# EAGLE schematic Backplane (EAGLE 7.2.0)

## Sheet 1 of 4
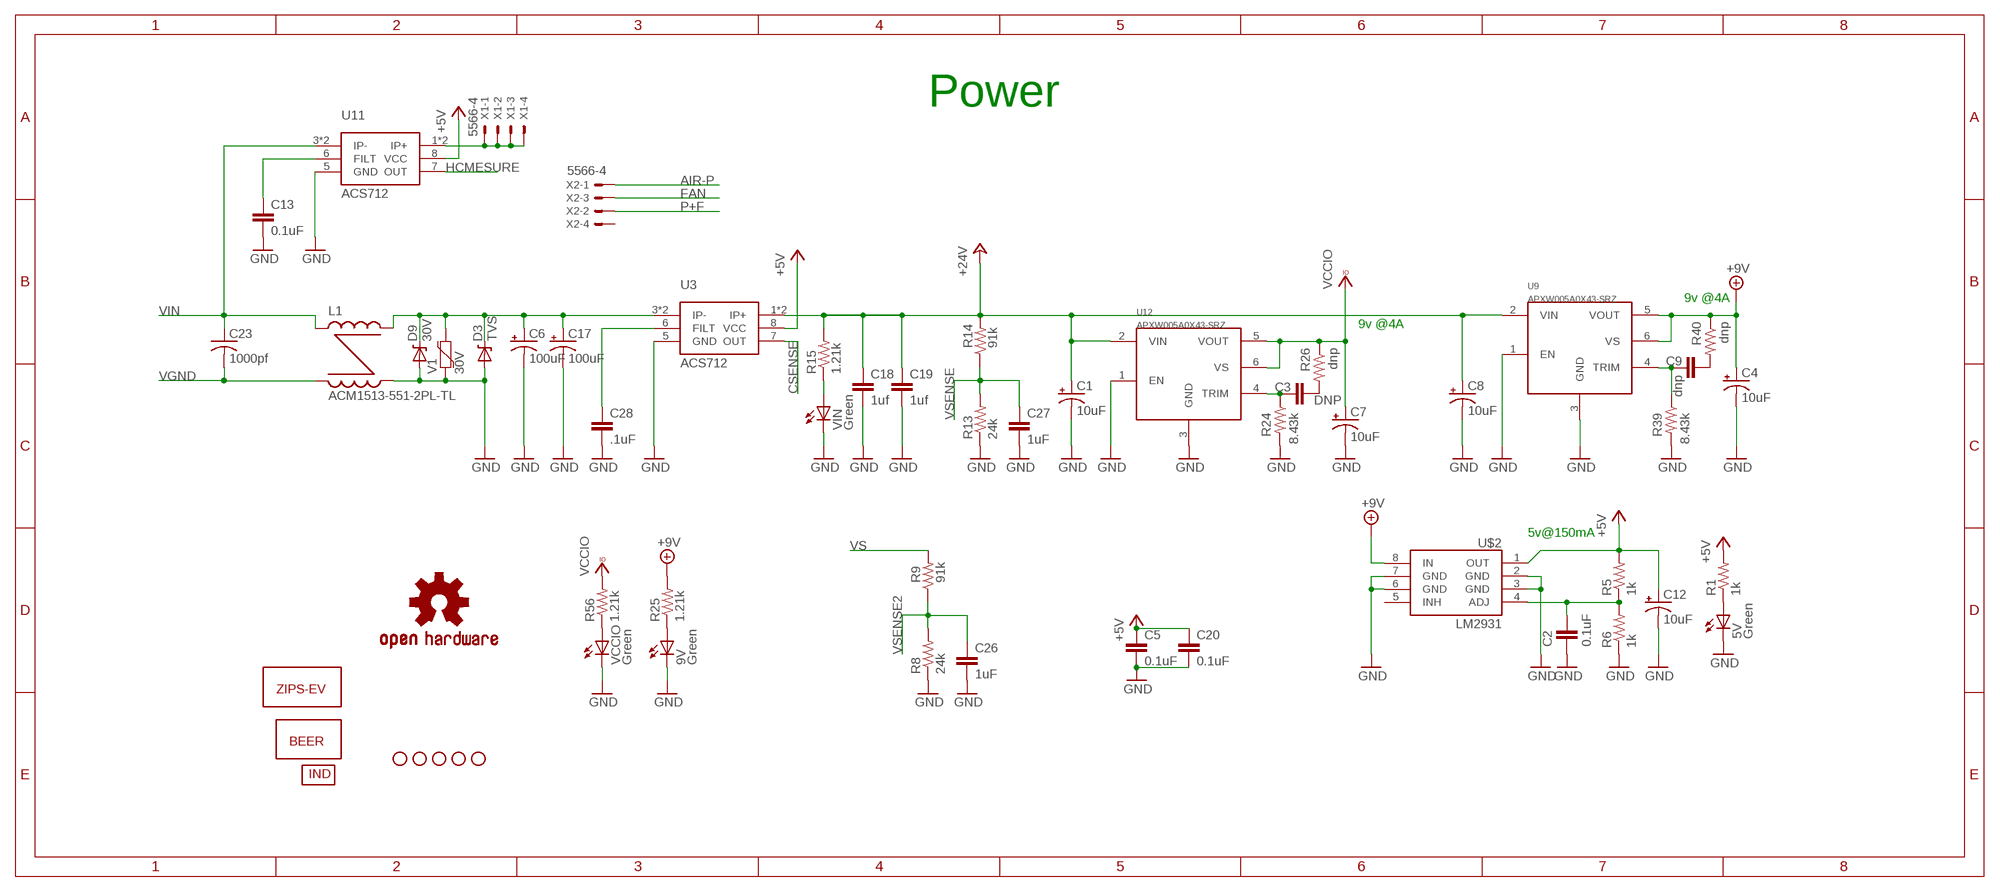
[diagram p0: schematic, sheet 1]

### Parts
5V  Green  LEDCHIP-LED0805  [CHIP-LED0805]
9V  Green  LEDCHIP-LED0805  [CHIP-LED0805]
C1  10uF  CAP_POL7343  [EIA7343]
C2  0.1uF  CAP0805  [0805]
C3  DNP  CAP0805  [0805]
C4  10uF  CAP_POL3528  [EIA3528]
C5  0.1uF  CAP0805  [0805]
C6  100uF  CPOL-USG  [PANASONIC_G]
C7  10uF  CAP_POL3528  [EIA3528]
C8  10uF  CAP_POL7343  [EIA7343]
C9  dnp  CAP0805  [0805]
C12  10uF  CAP_POL3528  [EIA3528]
C13  0.1uF  CAP0805  [0805]
C17  100uF  CPOL-USG  [PANASONIC_G]
C18  1uf  CAP1206  [1206]
C19  1uf  CAP1206  [1206]
C20  0.1uF  CAP0805  [0805]
C23  1000pf  C-USC1825  [C1825]
C26  1uF  CAP0805  [0805]
C27  1uF  CAP0805  [0805]
C28  .1uF  CAP0805  [0805]
D3  TVS  [DO-214AC]
D9  30V  DIODE-ZENERSMB  [SMB-DIODE]
L1  ACM1513-551-2PL-TL  [ACM1513-551-2PL-TL]
R1  1k  R-US_R0805  [R0805]
R5  1k  R-US_R0805  [R0805]
R6  1k  R-US_R0805  [R0805]
R8  24k  R-US_R0805  [R0805]
R9  91k  R-US_R0805  [R0805]
R13  24k  R-US_R0805  [R0805]
R14  91k  R-US_R0805  [R0805]
R15  1.21k  R-US_R0805  [R0805]
R24  8.43k  R-US_R0805  [R0805]
R25  1.21k  R-US_R0805  [R0805]
R26  dnp  R-US_R0805  [R0805]
R39  8.43k  R-US_R0805  [R0805]
R40  dnp  R-US_R0805  [R0805]
R56  1.21k  R-US_R0805  [R0805]
STANDOFF1  STAND-OFF  [STAND-OFF]
STANDOFF2  STAND-OFF  [STAND-OFF]
STANDOFF3  STAND-OFF  [STAND-OFF]
STANDOFF4  STAND-OFF  [STAND-OFF]
STANDOFF5  STAND-OFF  [STAND-OFF]
U3  ACS712  [SO-8]
U9  APXW005A0X43-SRZ  [APXW005A0X43-SRZ]
U11  ACS712  [SO-8]
U12  APXW005A0X43-SRZ  [APXW005A0X43-SRZ]
U$2  LM2931  [SO08]
U$3  BEERL  [B-L]
U$7  LOGO  [L-MS]
U$8  OSHW-LOGOM  [OSHW-LOGO-M]
U$9  INDPK1  [PICKIT-PIN-1]
V1  30V  VARISTOR-0603  [0603-RES]
VCCIO  Green  LEDCHIP-LED0805  [CHIP-LED0805]
VIN  Green  LEDCHIP-LED0805  [CHIP-LED0805]
X1  5566-4  [5566-4]
X2  5566-4  [5566-4]

### Nets
+5V: C5.1 C12.A(+) C20.1 R1.2 R5.2 U3.8(VCC) U11.8(VCC) U$2.1(OUT) ; also sheet 2,4
+9V: C4.A(+) R25.2 R40.1 U9.5(VOUT) U9.6(VS) U$2.8(IN) ; also sheet 2
+24V: C1.A(+) C8.A(+) C18.1 C19.1 R14.2 R15.2 U3.1(IP+) U3.2(IP+) U9.2(VIN) U12.2(VIN) ; also sheet 2,3,4
AIR-P: X2.1 ; also sheet 2
CSENSE: U3.7(OUT) ; also sheet 4
FAN: X2.3 ; also sheet 2
GND: 5V.C 9V.C C1.C(-) C2.2 C4.C(-) C5.2 C6.- C7.C(-) C8.C(-) C12.C(-) C13.2 C17.- C18.2 C19.2 C20.2 C26.2 C27.2 C28.2 D3.A D9.A L1.OUT- R6.1 R8.1 R13.1 R24.2 R39.2 U3.5(GND) U9.1(EN) U9.3(GND) U11.5(GND) U12.1(EN) U12.3(GND) U$2.2(GND) U$2.3(GND) U$2.6(GND) U$2.7(GND) V1.1 VCCIO.C VIN.C ; also sheet 2,3,4
HCMESURE: U11.7(OUT) ; also sheet 4
N$1: R56.1 VCCIO.A
N$3: C2.1 R5.1 R6.2 U$2.4(ADJ)
N$8: 9V.A R25.1
N$18: C28.1 U3.6(FILT)
N$19: 5V.A R1.1
N$30: C6.+ C17.+ D3.C D9.C L1.OUT+ U3.3(IP-) U3.4(IP-) V1.2
N$35: C3.1 R26.2
N$37: C3.2 R24.1 U12.4(TRIM)
N$42: R15.1 VIN.A
N$59: C9.1 R40.2
N$60: C9.2 R39.1 U9.4(TRIM)
N$61: U11.1(IP+) U11.2(IP+) X1.1 X1.2 X1.3 X1.4
N$63: C13.1 U11.6(FILT)
P+F: X2.2 ; also sheet 2
VCCIO: C7.A(+) R26.1 R56.2 U12.5(VOUT) U12.6(VS) ; also sheet 4
VGND: C23.2 L1.IN- ; also sheet 2
VIN: C23.1 L1.IN+ U11.3(IP-) U11.4(IP-) ; also sheet 2
VS: R9.2
VSENSE: C27.1 R13.2 R14.1 ; also sheet 4
VSENSE2: C26.1 R8.2 R9.1
Unconnected: U$2.5(INH) X2.4

### Notes on the sheet
- Power
- 9v @4A
- 9v @4A
- 5v@150mA

## Sheet 2 of 4
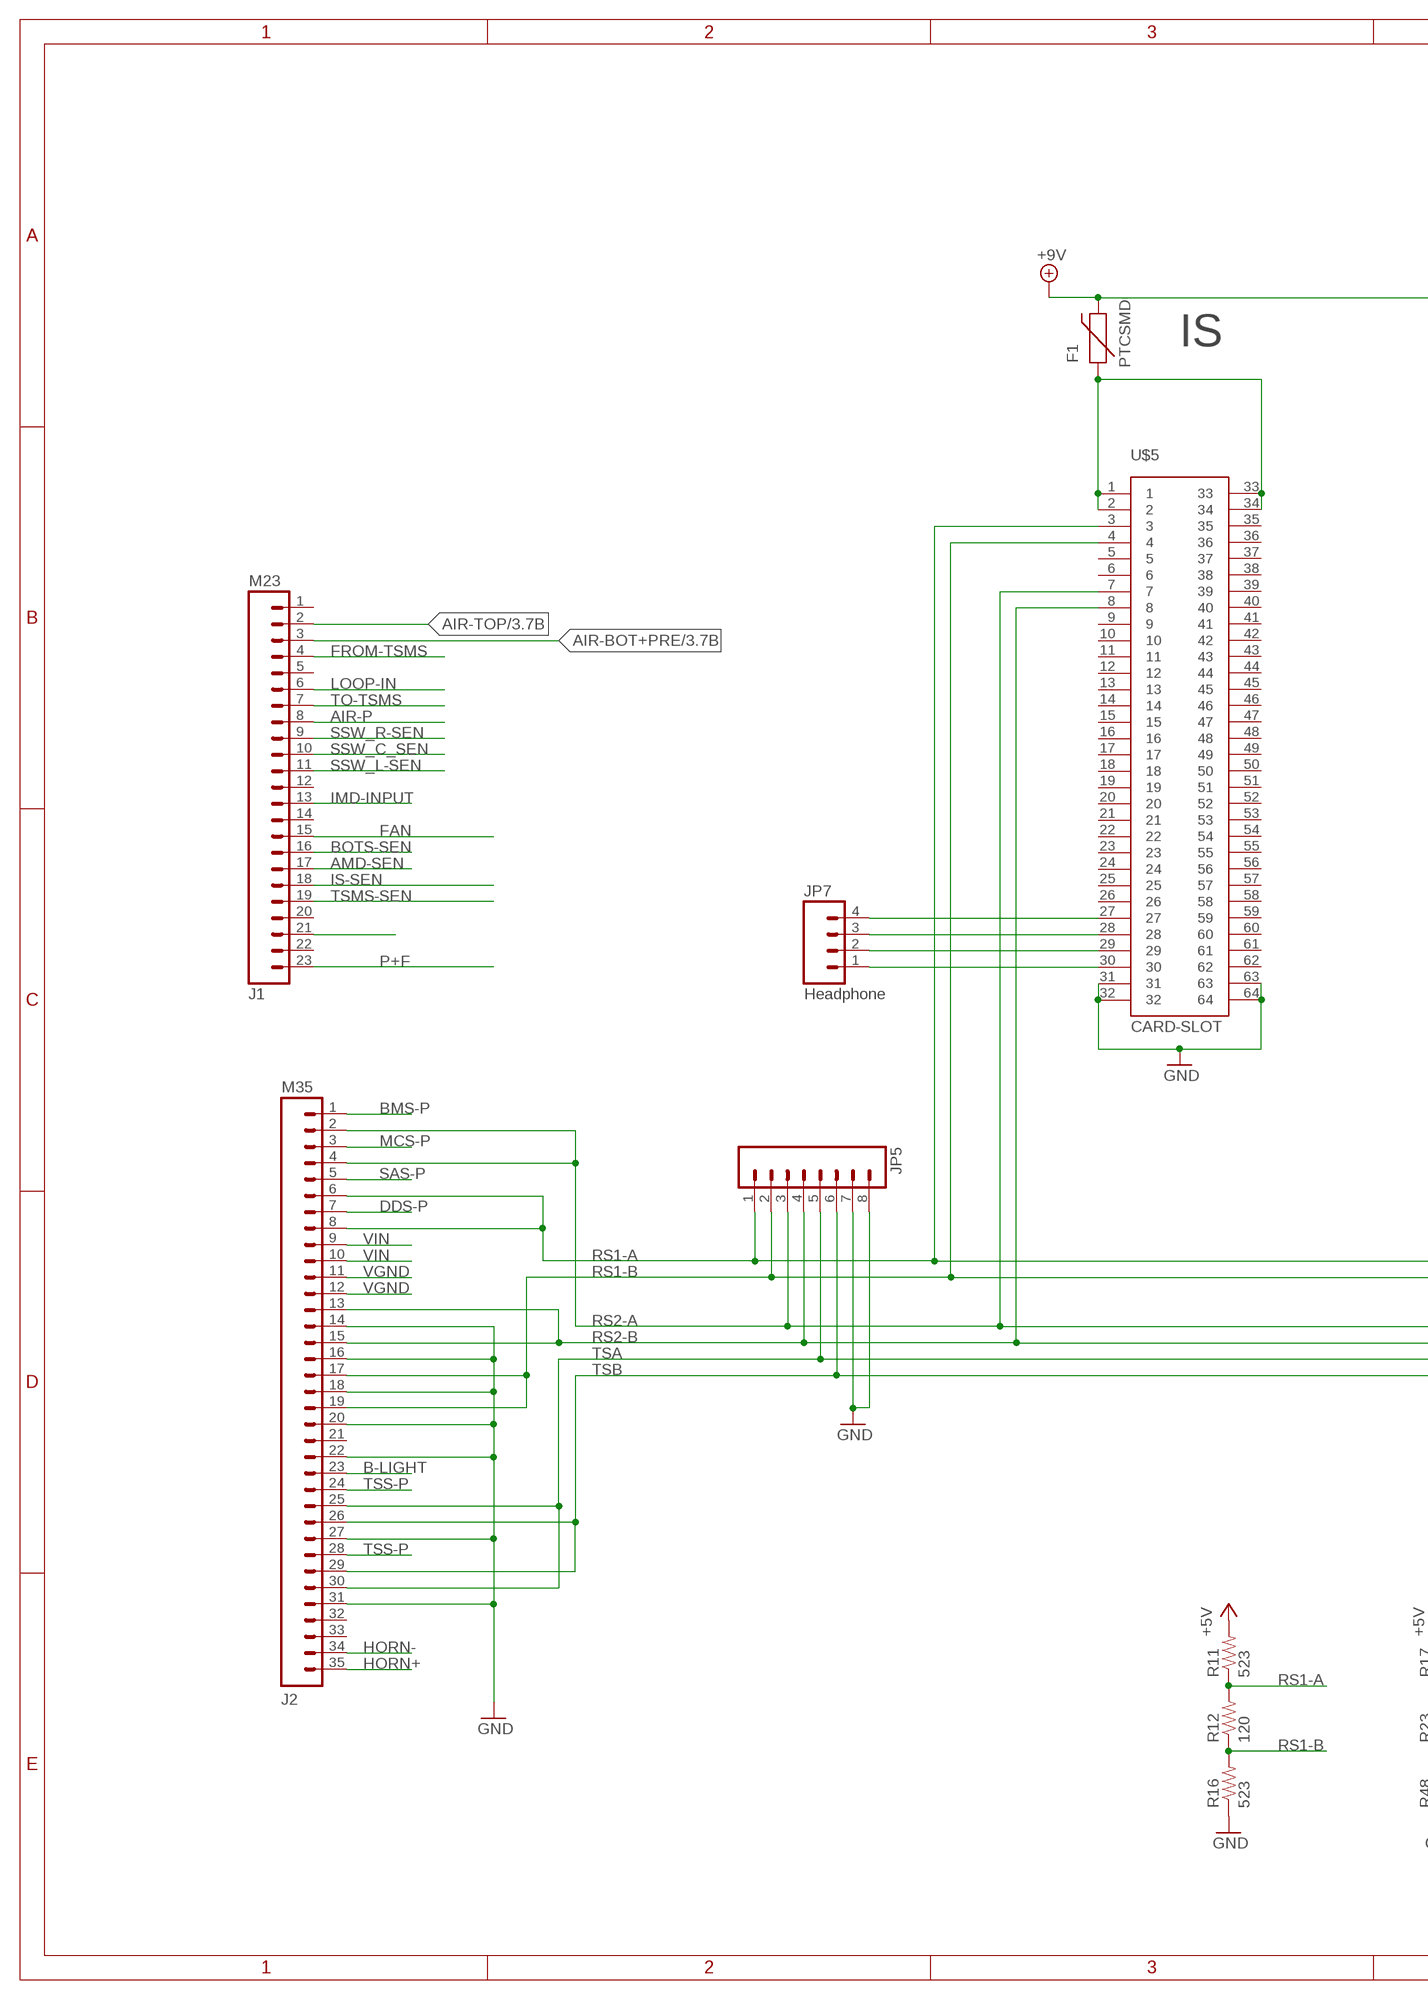
[diagram p1: schematic, sheet 2, part 1 of 2]
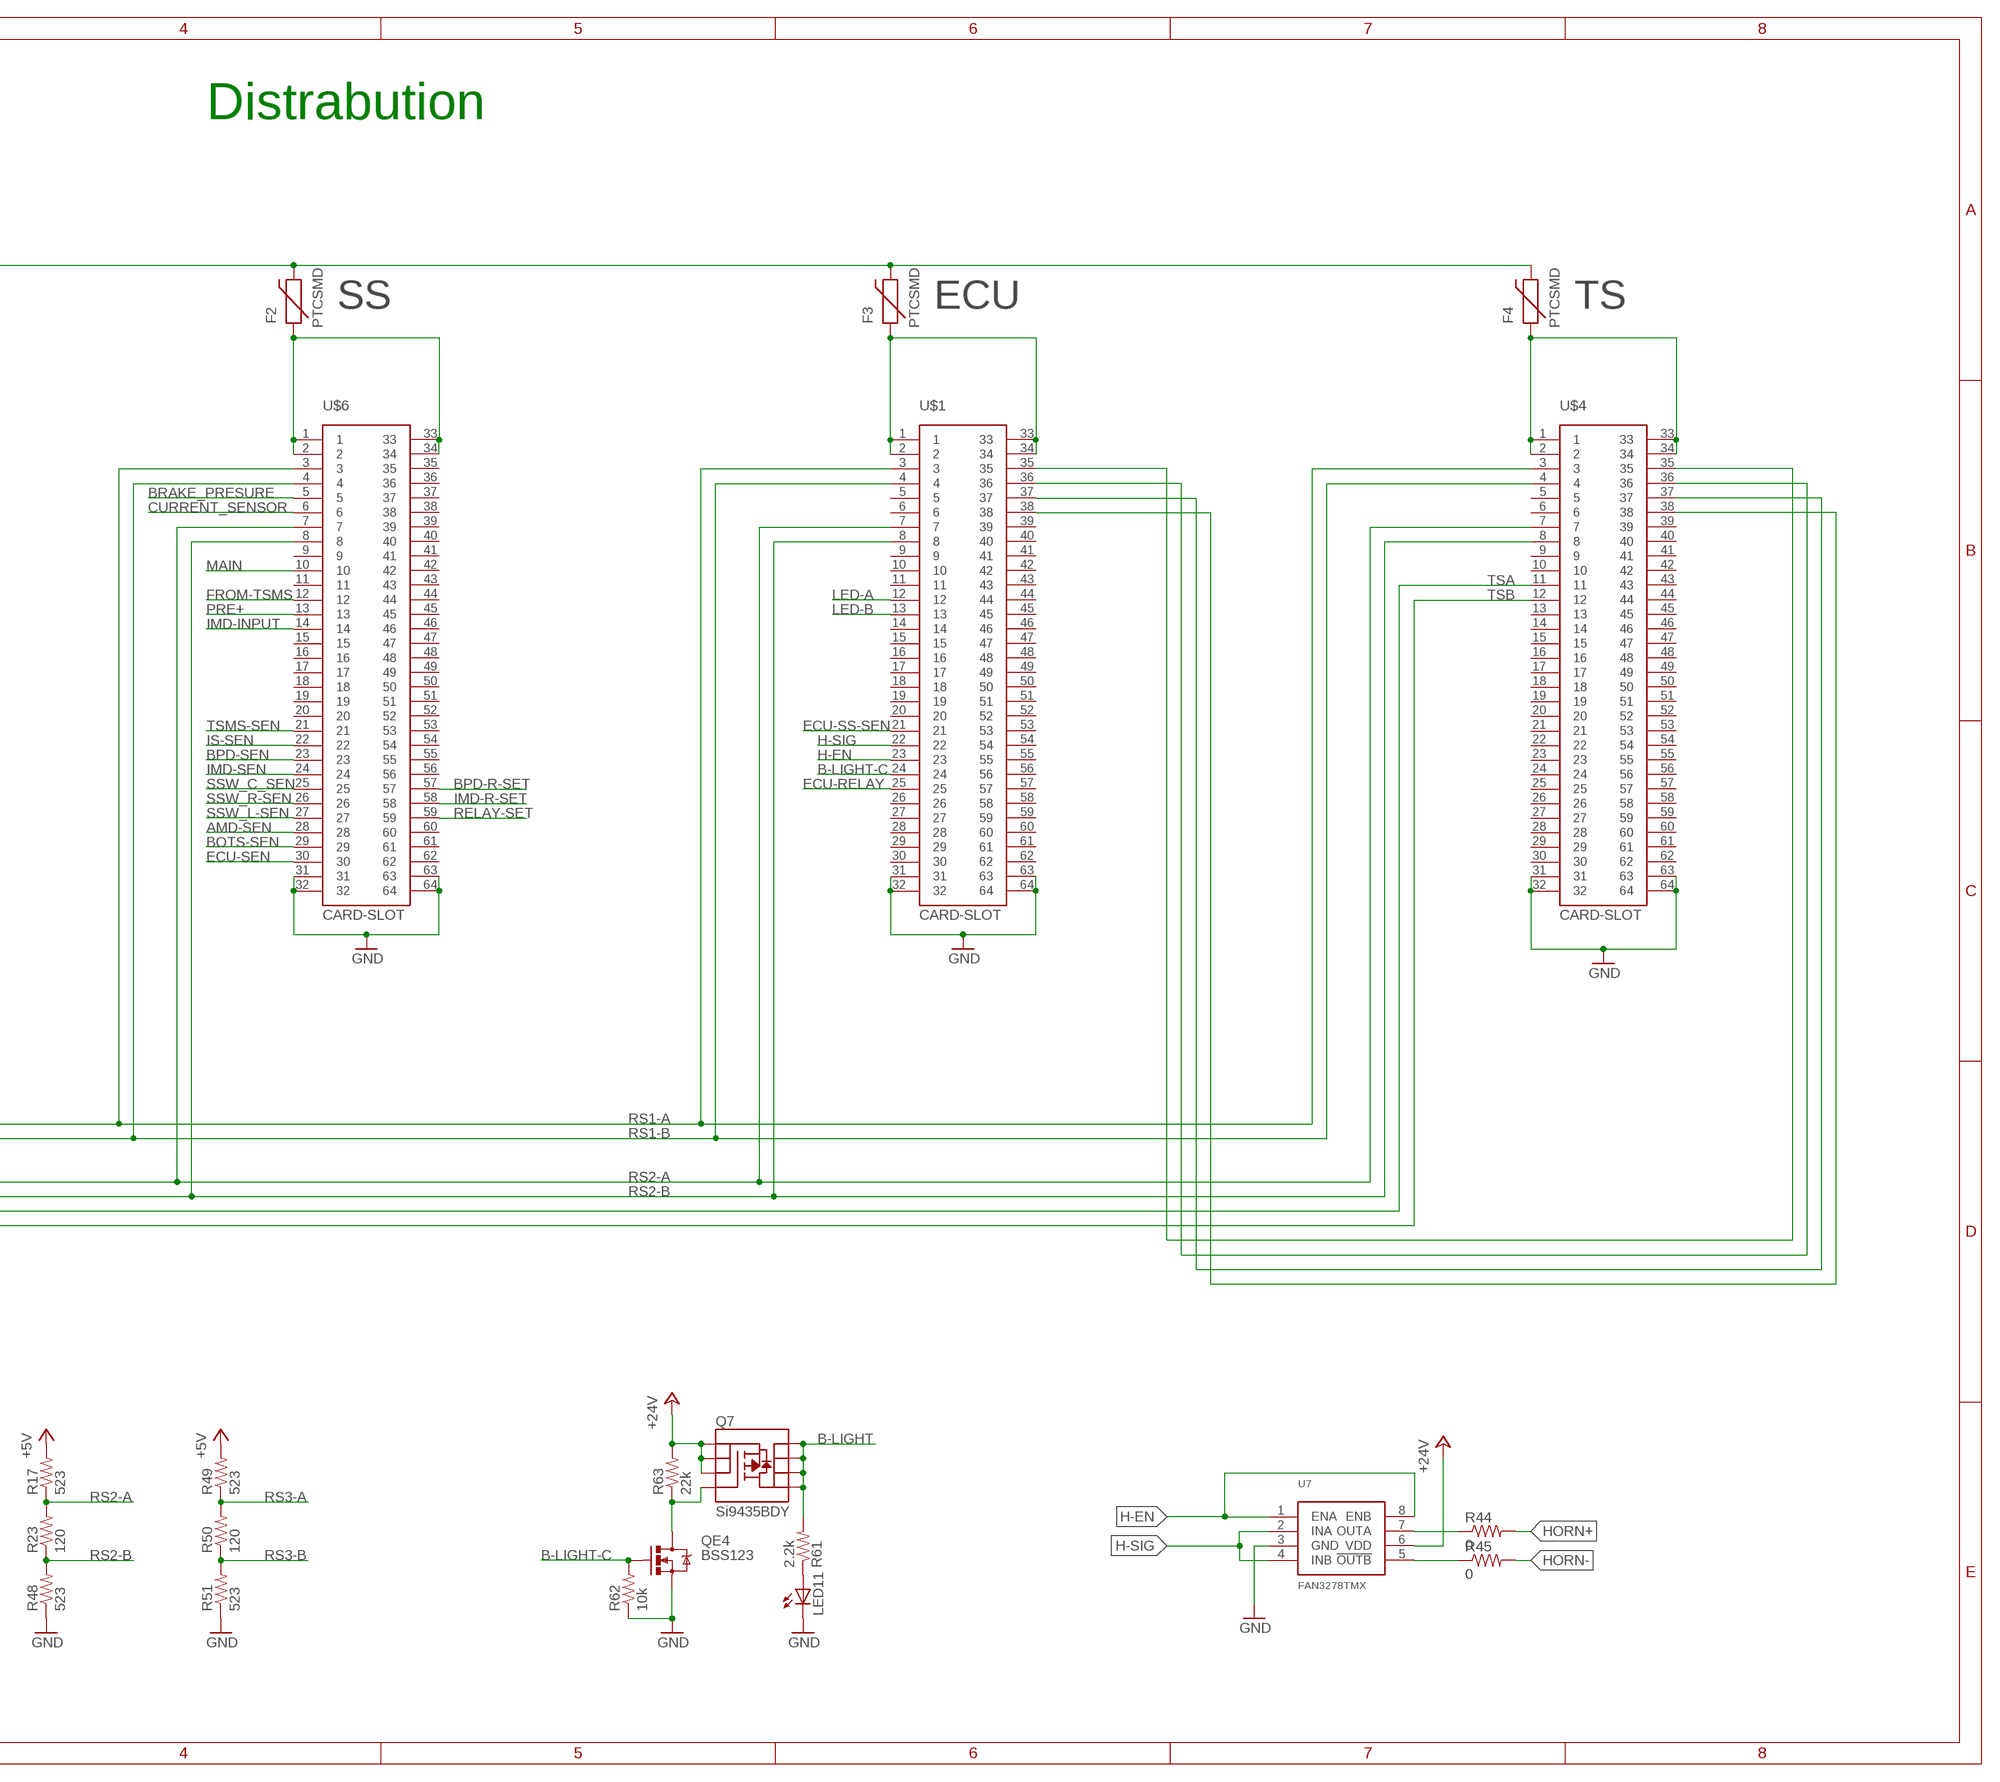
[diagram p2: schematic, sheet 2, part 2 of 2]

### Parts
F1  PTCSMD  [PTC-1206]
F2  PTCSMD  [PTC-1206]
F3  PTCSMD  [PTC-1206]
F4  PTCSMD  [PTC-1206]
J1  M23  [1-770669-1]
J2  M35  [1-776163-2]
JP5  M08LOCK_NO_SILK  [1X08_LOCK_NO_SILK]
JP7  Headphone  M04POLAR_LOCK  [MOLEX-1X4_LOCK]
LED11  LEDCHIP-LED0805  [CHIP-LED0805]
Q7  Si9435BDY  MOSFET-PCHANNEL-SOIC8SOIC8  [SO08]
QE4  BSS123  [SOT-23]
R11  523  RESISTOR0805-RES  [0805]
R12  120  RESISTOR0805-RES  [0805]
R16  523  RESISTOR0805-RES  [0805]
R17  523  RESISTOR0805-RES  [0805]
R23  120  RESISTOR0805-RES  [0805]
R44  0  RESISTOR0805-RES  [0805]
R45  0  RESISTOR0805-RES  [0805]
R48  523  RESISTOR0805-RES  [0805]
R49  523  RESISTOR0805-RES  [0805]
R50  120  RESISTOR0805-RES  [0805]
R51  523  RESISTOR0805-RES  [0805]
R61  2.2k  RESISTOR0805-RES  [0805]
R62  10k  RESISTOR0805-RES  [0805]
R63  22k  RESISTOR0805-RES  [0805]
U7  FAN3278TMX  [SO-8]
U$1  CARD-SLOT  [CS64]
U$4  CARD-SLOT  [CS64]
U$5  CARD-SLOT  [CS64]
U$6  CARD-SLOT  [CS64]

### Nets
+5V: R11.2 R17.2 R49.2 ; also sheet 1,4
+9V: F1.2 F2.2 F3.2 F4.2 ; also sheet 1
+24V: Q7.1(S) Q7.2(S) Q7.3(S) R63.2 U7.6(VDD) ; also sheet 1,3,4
AIR-BOT+PRE: J1.3 ; also sheet 3
AIR-P: J1.8 ; also sheet 1
AIR-TOP: J1.2 ; also sheet 3
AMD-SEN: J1.17 U$6.28
B-LIGHT: J2.23 Q7.5(D) Q7.6(D) Q7.7(D) Q7.8(D) R61.2
B-LIGHT-C: QE4.1(G) R62.2 U$1.24
BMS-P: J2.1 ; also sheet 4
BOTS-SEN: J1.16 U$6.29
BPD-R-SET: U$6.57 ; also sheet 3
BPD-SEN: U$6.23 ; also sheet 3
BRAKE_PRESURE: U$6.5
CURRENT_SENSOR: U$6.6
DDS-P: J2.7 ; also sheet 4
ECU-RELAY: U$1.25 ; also sheet 3
ECU-SEN: U$6.30 ; also sheet 3
ECU-SS-SEN: U$1.21
FAN: J1.15 ; also sheet 1
FROM-TSMS: J1.4 U$6.12 ; also sheet 3
GND: J2.14 J2.16 J2.18 J2.20 J2.22 J2.27 J2.31 JP5.7 JP5.8 LED11.C QE4.2(S) R16.1 R48.1 R51.1 R62.1 U7.3(GND) U$1.31 U$1.32 U$1.63 U$1.64 U$4.31 U$4.32 U$4.63 U$4.64 U$5.31 U$5.32 U$5.63 U$5.64 U$6.31 U$6.32 U$6.63 U$6.64 ; also sheet 1,3,4
H-EN: U7.1(ENA) U7.8(ENB) U$1.23
H-SIG: U7.2(INA) U7.4(INB) U$1.22
HORN+: J2.35 R44.2
HORN-: J2.34 R45.2
IMD-INPUT: J1.13 U$6.14
IMD-R-SET: U$6.58 ; also sheet 3
IMD-SEN: U$6.24 ; also sheet 3
IS-SEN: J1.18 U$6.22
LED-A: U$1.12
LED-B: U$1.13
LOOP-IN: J1.6 ; also sheet 3
MAIN: U$6.10 ; also sheet 3
MCS-P: J2.3 ; also sheet 4
N$5: F1.1 U$5.1 U$5.2 U$5.33 U$5.34
N$9: F2.1 U$6.1 U$6.2 U$6.33 U$6.34
N$12: F3.1 U$1.1 U$1.2 U$1.33 U$1.34
N$13: F4.1 U$4.1 U$4.2 U$4.33 U$4.34
N$20: JP7.1 U$5.30
N$32: Q7.4(G) QE4.3(D) R63.1
N$34: LED11.A R61.1
N$38: JP7.2 U$5.29
N$41: U$1.38 U$4.38
N$52: R44.1 U7.7(OUTA)
N$53: R45.1 U7.5(!OUTB)
N$56: JP7.3 U$5.28
N$57: U$1.37 U$4.37
N$81: JP7.4 U$5.27
N$82: J1.21
P+F: J1.23 ; also sheet 1
PRE+: U$6.13 ; also sheet 3
RELAY-SET: U$6.59 ; also sheet 3
RS1-A: J2.6 J2.8 JP5.1 R11.1 R12.2 U$1.3 U$4.3 U$5.3 U$6.3
RS1-B: J2.17 J2.19 JP5.2 R12.1 R16.2 U$1.4 U$4.4 U$5.4 U$6.4
RS2-A: J2.2 J2.4 JP5.3 R17.1 R23.2 U$1.7 U$4.7 U$5.7 U$6.7 ; also sheet 4
RS2-B: J2.13 J2.15 JP5.4 R23.1 R48.2 U$1.8 U$4.8 U$5.8 U$6.8 ; also sheet 4
RS3-A: R49.1 R50.2 U$1.35 U$4.35
RS3-B: R50.1 R51.2 U$1.36 U$4.36
SAS-P: J2.5 ; also sheet 4
SSW_C_SEN: J1.10 U$6.25
SSW_L-SEN: J1.11 U$6.27
SSW_R-SEN: J1.9 U$6.26
TO-TSMS: J1.7 ; also sheet 3
TSA: J2.25 J2.30 JP5.5 U$4.11
TSB: J2.26 J2.29 JP5.6 U$4.12
TSMS-SEN: J1.19 U$6.21
TSS-P: J2.24 J2.28 ; also sheet 4
VGND: J2.11 J2.12 ; also sheet 1
VIN: J2.9 J2.10 ; also sheet 1
Unconnected: J1.1 J1.5 J1.12 J1.14 J1.20 J1.22 J2.21 J2.32 J2.33 U$1.5 U$1.6 U$1.9 U$1.10 U$1.11 U$1.14 U$1.15 U$1.16 U$1.17 U$1.18 U$1.19 U$1.20 U$1.26 U$1.27 U$1.28 U$1.29 U$1.30 U$1.39 U$1.40 U$1.41 U$1.42 U$1.43 U$1.44 U$1.45 U$1.46 U$1.47 U$1.48 U$1.49 U$1.50 U$1.51 U$1.52 U$1.53 U$1.54 U$1.55 U$1.56 U$1.57 U$1.58 U$1.59 U$1.60 U$1.61 U$1.62 U$4.5 U$4.6 U$4.9 U$4.10 U$4.13 U$4.14 U$4.15 U$4.16 U$4.17 U$4.18 U$4.19 U$4.20 U$4.21 U$4.22 U$4.23 U$4.24 U$4.25 U$4.26 U$4.27 U$4.28 U$4.29 U$4.30 U$4.39 U$4.40 U$4.41 U$4.42 U$4.43 U$4.44 U$4.45 U$4.46 U$4.47 U$4.48 U$4.49 U$4.50 U$4.51 U$4.52 U$4.53 U$4.54 U$4.55 U$4.56 U$4.57 U$4.58 U$4.59 U$4.60 U$4.61 U$4.62 U$5.5 U$5.6 U$5.9 U$5.10 U$5.11 U$5.12 U$5.13 U$5.14 U$5.15 U$5.16 U$5.17 U$5.18 U$5.19 U$5.20 U$5.21 U$5.22 U$5.23 U$5.24 U$5.25 U$5.26 U$5.35 U$5.36 U$5.37 U$5.38 U$5.39 U$5.40 U$5.41 U$5.42 U$5.43 U$5.44 U$5.45 U$5.46 U$5.47 U$5.48 U$5.49 U$5.50 U$5.51 U$5.52 U$5.53 U$5.54 U$5.55 U$5.56 U$5.57 U$5.58 U$5.59 U$5.60 U$5.61 U$5.62 U$6.9 U$6.11 U$6.15 U$6.16 U$6.17 U$6.18 U$6.19 U$6.20 U$6.35 U$6.36 U$6.37 U$6.38 U$6.39 U$6.40 U$6.41 U$6.42 U$6.43 U$6.44 U$6.45 U$6.46 U$6.47 U$6.48 U$6.49 U$6.50 U$6.51 U$6.52 U$6.53 U$6.54 U$6.55 U$6.56 U$6.60 U$6.61 U$6.62